# EAGLE board Mk4 Prototype (EAGLE 9.0.1), part 1 of 2
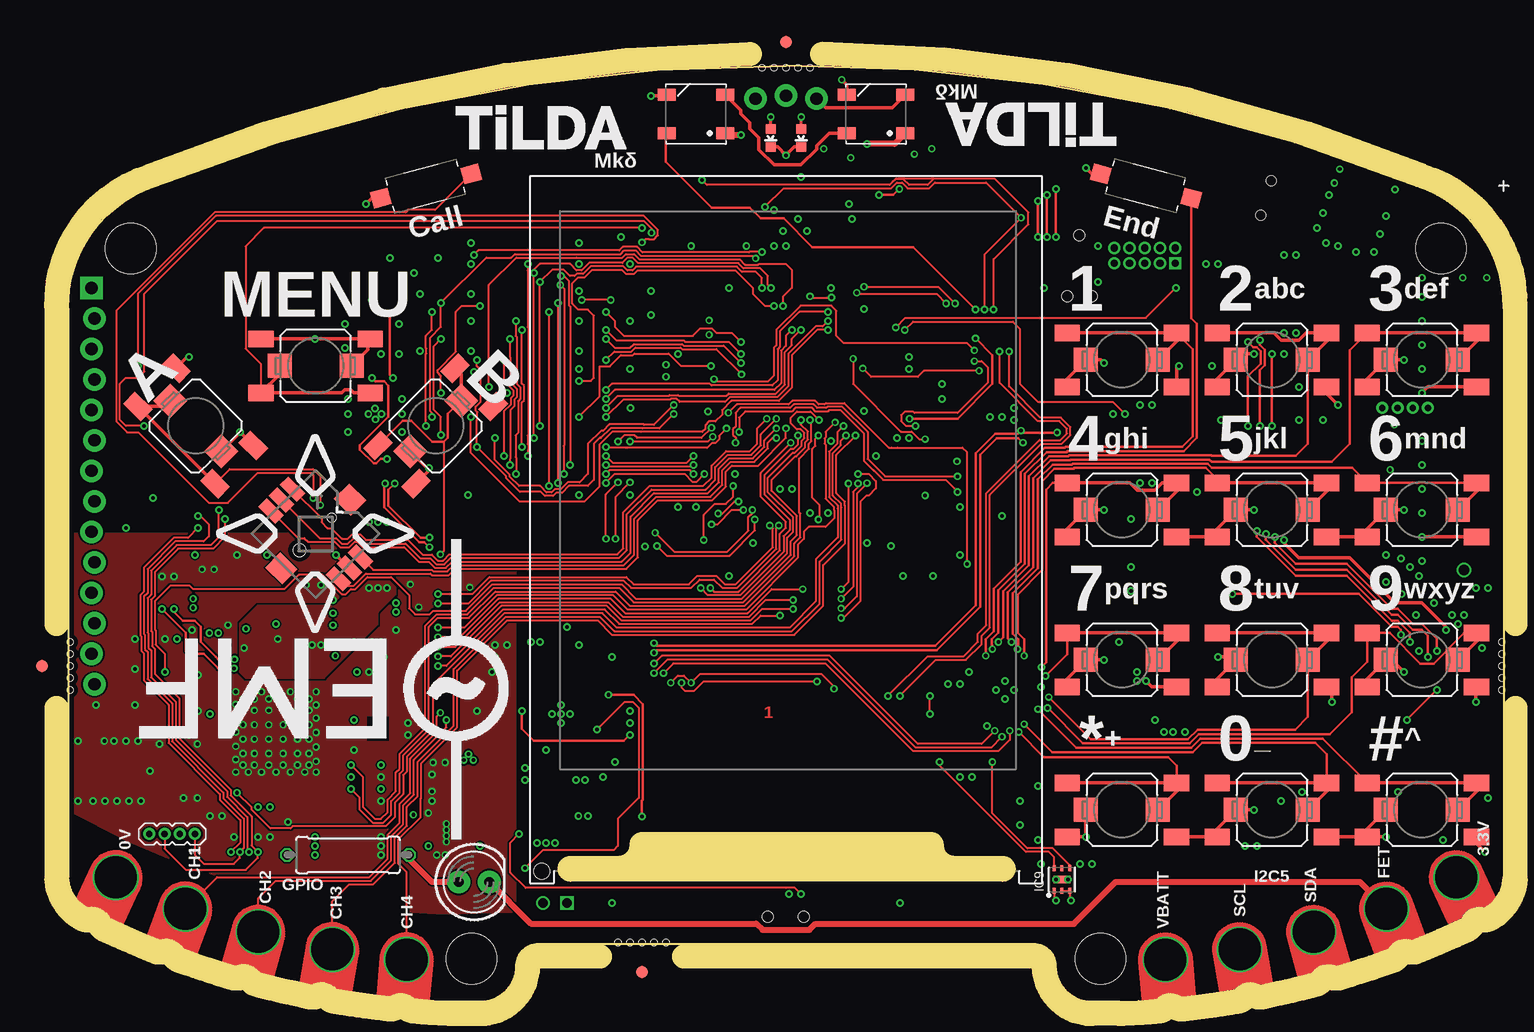
[diagram p4: board, top side]
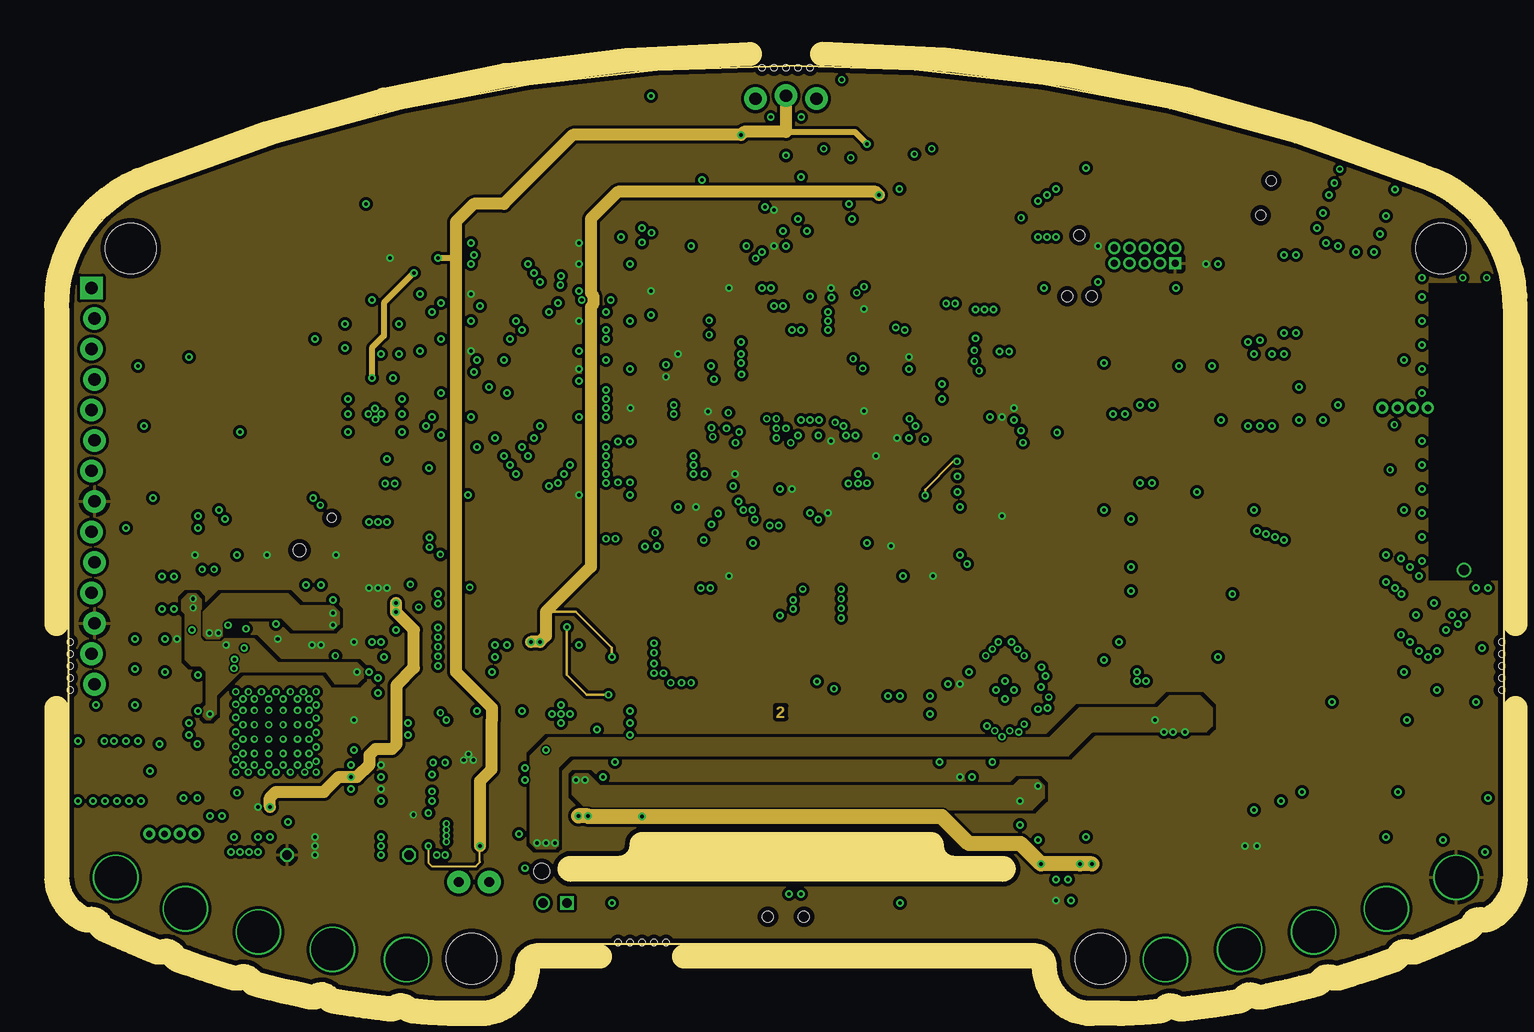
[diagram p5: board, inner layer 3V3@2]
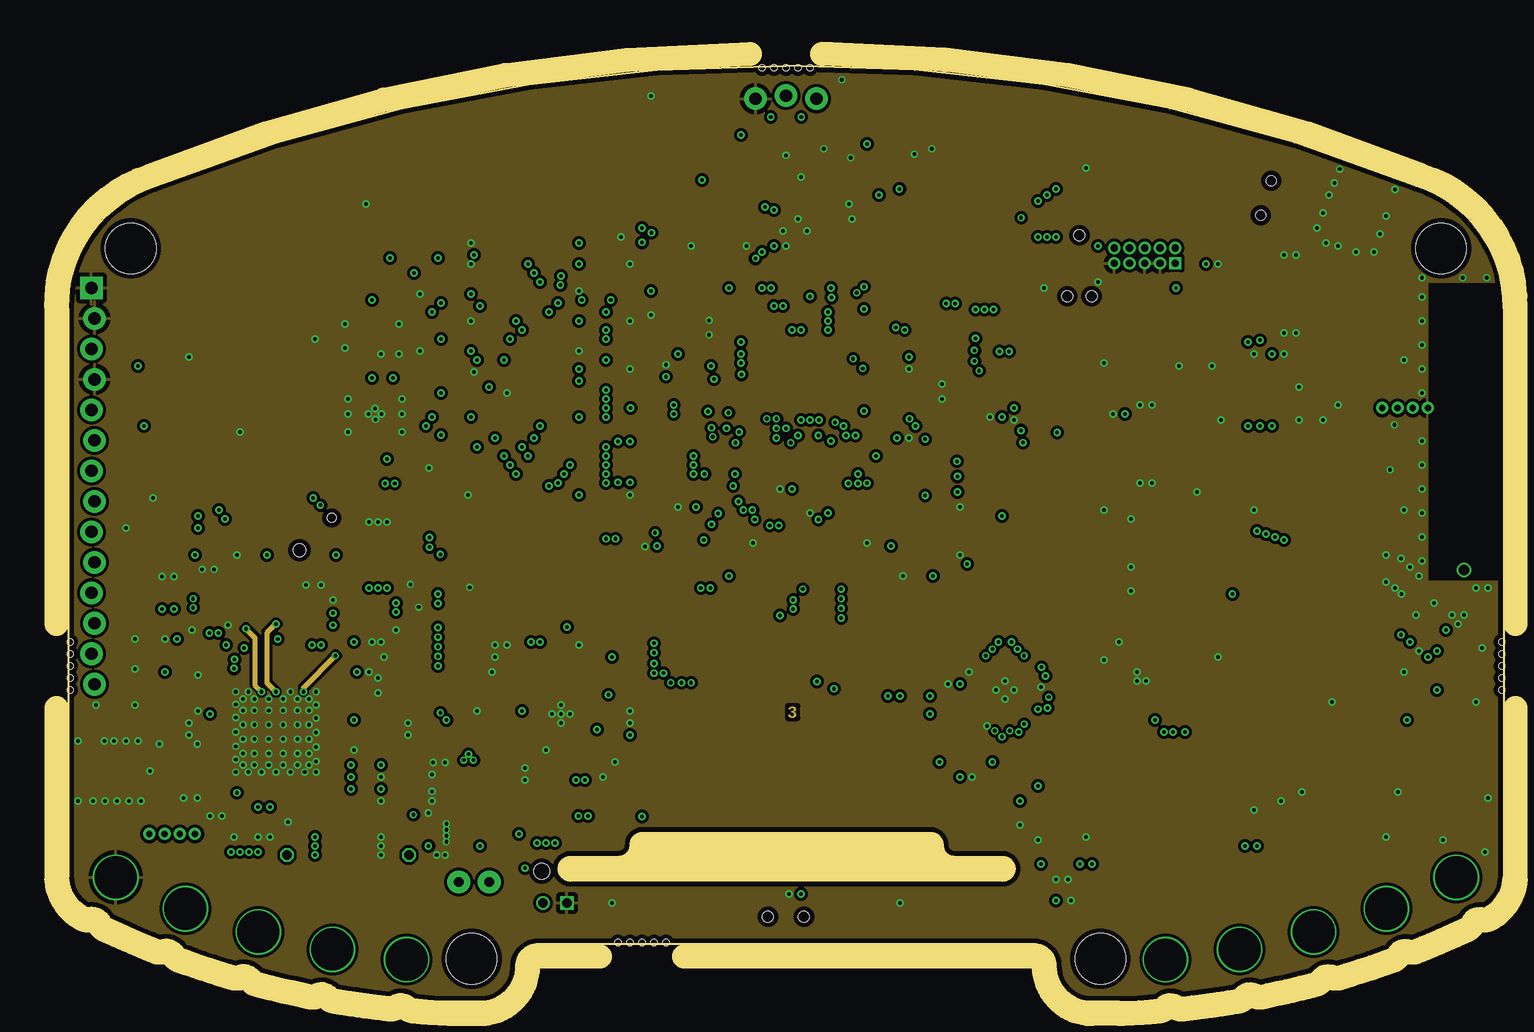
[diagram p6: board, inner layer GND@3]
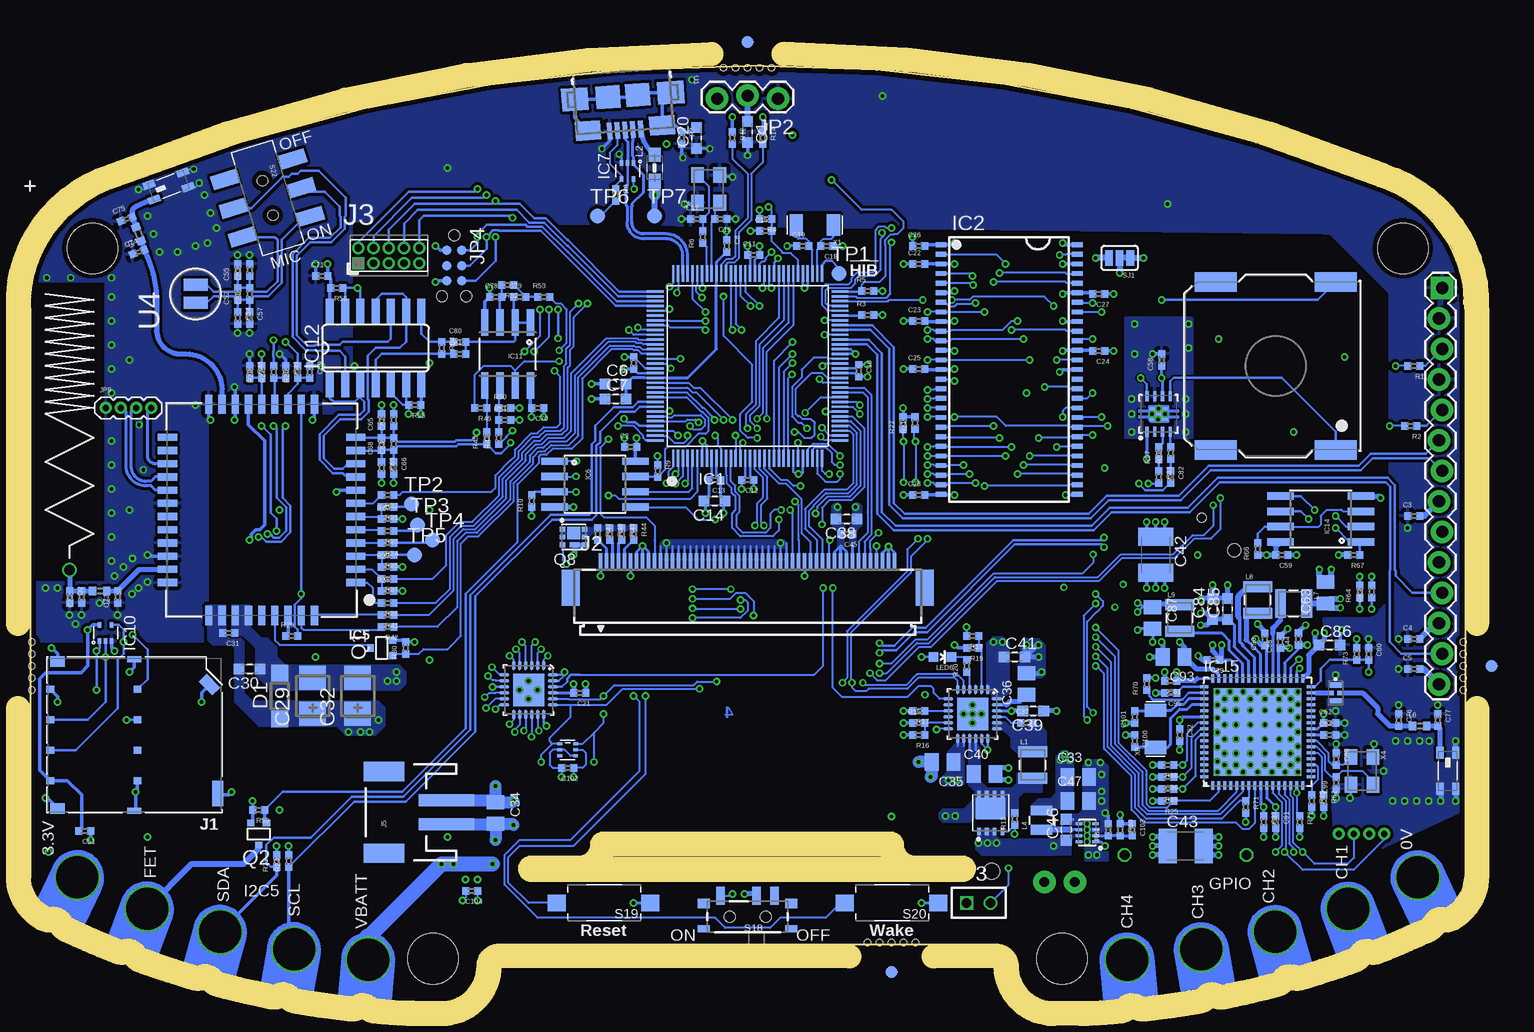
[diagram p7: board, bottom side, seen from below]

Size 119.6 x 78 mm. Coordinates in mm from the lower left corner, seen from the top.
Copper layers (1+2*15+16): Top 0.035mm / dielectric 0.22mm / 3V3@2 0.017mm / dielectric 1mm / GND@3 0.017mm / dielectric 0.22mm / Bottom 0.035mm
Design rules "little015mm  Round 4layer Newbury *": minimum track width 0.15mm, minimum drill 0.3mm, track to track 0.15mm, track to pad 0.15mm, pad to pad 0.15mm, via to via 0.15mm, smd to smd 0.15mm, copper to edge 0.4mm, drill to drill 0.3mm, minimum pad ring 0.15mm, minimum via ring 0.15mm, stop-mask expansion 0.1mm, vias tented up to drill 0.6mm, thermal gap 14mil
Net classes: 1 50R Single: width 0.4 mm, clearance 0.4 mm to class 0, clearance 0.4 mm; 2 90R Diff: width 0.25 mm, clearance 0.25 mm to class 0, clearance 0.4 mm to class 1, clearance 0.15 mm; 3 100R Diff: width 0.22 mm, clearance 0.25 mm to class 0, clearance 0.4 mm to class 1, clearance 0.25 mm to class 2, clearance 0.15 mm; 4 Audio: width 0.2 mm, clearance 0.25 mm to class 0, clearance 0.4 mm to class 1, clearance 0.25 mm to class 2, clearance 0.25 mm to class 3, clearance 0.15 mm
bRestrict: area 10.9,29.4 to 11.5,30.1

## Footprints (pad centres in the part's own frame; a part is rotated, then mirrored left to right if it is on the bottom)
2450AT18D0100 = smd 1 x 0.6: 1 -1.5,-0.65; 2 1.5,-0.65; 3 1.5,0.65; 4 -1.5,0.65
C0603K-SMALL = smd 0.889 x 0.889: 1 -0.875,0; 2 0.875,0
C0402-SMALLER = smd 0.6 x 0.6: 1 -0.5,0; 2 0.5,0
CT3528 = smd 2 x 2.2: + -1.5,0; - 1.5,0
C0805-N = smd 1.15 x 1.45: 1 -0.9,0; 2 0.9,0
C1210K = smd 1.5 x 2.9: 1 -1.5,0; 2 1.5,0
SOD123 = smd 1.4 x 1.4: A 1.9,0; C -1.9,0
R0402-SMALLER = smd 0.6 x 0.6: 1 -0.5,0; 2 0.5,0
FIDUCIAL-1X2.5-STOP = smd 1 x 1: 1 0,0
DEA202450BT = smd 0.45 x 1: GND@2 0.65,0; GND@4 -0.65,0 | smd 0.35 x 0.35: IN 0,-0.325; OUT 0,0.325
QFP128-0.4 = smd 0.2 x 1.4: 1 -6.2,-7.7; 2 -5.8,-7.7; 3 -5.4,-7.7; 4 -5,-7.7; 5 -4.6,-7.7; 6 -4.2,-7.7; 7 -3.8,-7.7; 8 -3.4,-7.7; 9 -3,-7.7; 10 -2.6,-7.7; 11 -2.2,-7.7; 12 -1.8,-7.7; 13 -1.4,-7.7; 14 -1,-7.7; 15 -0.6,-7.7; 16 -0.2,-7.7; 17 0.2,-7.7; 18 0.6,-7.7; 19 1,-7.7; 20 1.4,-7.7; 21 1.8,-7.7; 22 2.2,-7.7; 23 2.6,-7.7; 24 3,-7.7; 25 3.4,-7.7; 26 3.8,-7.7; 27 4.2,-7.7; 28 4.6,-7.7; 29 5,-7.7; 30 5.4,-7.7; 31 5.8,-7.7; 32 6.2,-7.7; 65 6.2,7.7; 66 5.8,7.7; 67 5.4,7.7; 68 5,7.7; 69 4.6,7.7; 70 4.2,7.7; 71 3.8,7.7; 72 3.4,7.7; 73 3,7.7; 74 2.6,7.7; 75 2.2,7.7; 76 1.8,7.7; 77 1.4,7.7; 78 1,7.7; 79 0.6,7.7; 80 0.2,7.7; 81 -0.2,7.7; 82 -0.6,7.7; 83 -1,7.7; 84 -1.4,7.7; 85 -1.8,7.7; 86 -2.2,7.7; 87 -2.6,7.7; 88 -3,7.7; 89 -3.4,7.7; 90 -3.8,7.7; 91 -4.2,7.7; 92 -4.6,7.7; 93 -5,7.7; 94 -5.4,7.7; 95 -5.8,7.7; 96 -6.2,7.7 | smd 1.4 x 0.2: 33 7.7,-6.2; 34 7.7,-5.8; 35 7.7,-5.4; 36 7.7,-5; 37 7.7,-4.6; 38 7.7,-4.2; 39 7.7,-3.8; 40 7.7,-3.4; 41 7.7,-3; 42 7.7,-2.6; 43 7.7,-2.2; 44 7.7,-1.8; 45 7.7,-1.4; 46 7.7,-1; 47 7.7,-0.6; 48 7.7,-0.2; 49 7.7,0.2; 50 7.7,0.6; 51 7.7,1; 52 7.7,1.4; 53 7.7,1.8; 54 7.7,2.2; 55 7.7,2.6; 56 7.7,3; 57 7.7,3.4; 58 7.7,3.8; 59 7.7,4.2; 60 7.7,4.6; 61 7.7,5; 62 7.7,5.4; 63 7.7,5.8; 64 7.7,6.2; 97 -7.7,6.2; 98 -7.7,5.8; 99 -7.7,5.4; 100 -7.7,5; 101 -7.7,4.6; 102 -7.7,4.2; 103 -7.7,3.8; 104 -7.7,3.4; 105 -7.7,3; 106 -7.7,2.6; 107 -7.7,2.2; 108 -7.7,1.8; 109 -7.7,1.4; 110 -7.7,1; 111 -7.7,0.6; 112 -7.7,0.2; 113 -7.7,-0.2; 114 -7.7,-0.6; 115 -7.7,-1; 116 -7.7,-1.4; 117 -7.7,-1.8; 118 -7.7,-2.2; 119 -7.7,-2.6; 120 -7.7,-3; 121 -7.7,-3.4; 122 -7.7,-3.8; 123 -7.7,-4.2; 124 -7.7,-4.6; 125 -7.7,-5; 126 -7.7,-5.4; 127 -7.7,-5.8; 128 -7.7,-6.2
TSOP54-400 = smd 0.4 x 0.9: 1 -10.4,-5.68; 2 -9.6,-5.68; 3 -8.8,-5.68; 4 -8,-5.68; 5 -7.2,-5.68; 6 -6.4,-5.68; 7 -5.6,-5.68; 8 -4.8,-5.68; 9 -4,-5.68; 10 -3.2,-5.68; 11 -2.4,-5.68; 12 -1.6,-5.68; 13 -0.8,-5.68; 14 0,-5.68; 15 0.8,-5.68; 16 1.6,-5.68; 17 2.4,-5.68; 18 3.2,-5.68; 19 4,-5.68; 20 4.8,-5.68; 21 5.6,-5.68; 22 6.4,-5.68; 23 7.2,-5.68; 24 8,-5.68; 25 8.8,-5.68; 26 9.6,-5.68; 27 10.4,-5.68; 28 10.4,5.68; 29 9.6,5.68; 30 8.8,5.68; 31 8,5.68; 32 7.2,5.68; 33 6.4,5.68; 34 5.6,5.68; 35 4.8,5.68; 36 4,5.68; 37 3.2,5.68; 38 2.4,5.68; 39 1.6,5.68; 40 0.8,5.68; 41 0,5.68; 42 -0.8,5.68; 43 -1.6,5.68; 44 -2.4,5.68; 45 -3.2,5.68; 46 -4,5.68; 47 -4.8,5.68; 48 -5.6,5.68; 49 -6.4,5.68; 50 -7.2,5.68; 51 -8,5.68; 52 -8.8,5.68; 53 -9.6,5.68; 54 -10.4,5.68
VSON-HR = smd 0.55 x 0.25: 1 -0.675,0.75; 2 -0.675,0.25; 3 -0.675,-0.25; 4 -0.675,-0.75; 5 0.675,-0.75; 6 0.675,-0.25; 7 0.675,0.25; 8 0.675,0.75
QFN-24 = smd 0.85 x 0.25: 1 -2.05,1.25; 2 -2.05,0.75; 3 -2.05,0.25; 4 -2.05,-0.25; 5 -2.05,-0.75; 6 -2.05,-1.25; 13 2.05,-1.25; 14 2.05,-0.75; 15 2.05,-0.25; 16 2.05,0.25; 17 2.05,0.75; 18 2.05,1.25 | smd 0.25 x 0.9: 7 -1.25,-2.025; 8 -0.75,-2.025; 9 -0.25,-2.025; 10 0.25,-2.025; 11 0.75,-2.025; 12 1.25,-2.025; 19 1.25,2.025; 20 0.75,2.025; 21 0.25,2.025; 22 -0.25,2.025; 23 -0.75,2.025; 24 -1.25,2.025 | smd 2.7 x 2.6: 25 0,0
SIM800C = smd 1.6 x 0.6: 1 -7.85,6.05; 2 -7.85,4.95; 3 -7.85,3.85; 4 -7.85,2.75; 5 -7.85,1.65; 6 -7.85,0.55; 7 -7.85,-0.55; 8 -7.85,-1.65; 9 -7.85,-2.75; 10 -7.85,-3.85; 11 -7.85,-4.95; 12 -7.85,-6.05; 22 7.85,-6.05; 23 7.85,-4.95; 24 7.85,-3.85; 25 7.85,-2.75; 26 7.85,-1.65; 27 7.85,-0.55; 28 7.85,0.55; 29 7.85,1.65; 30 7.85,2.75; 31 7.85,3.85; 32 7.85,4.95; 33 7.85,6.05 | smd 0.6 x 1.6: 13 -4.4,-8.8; 14 -3.3,-8.8; 15 -2.2,-8.8; 16 -1.1,-8.8; 17 0,-8.8; 18 1.1,-8.8; 19 2.2,-8.8; 20 3.3,-8.8; 21 4.4,-8.8; 34 4.4,8.8; 35 3.3,8.8; 36 2.2,8.8; 37 1.1,8.8; 38 0,8.8; 39 -1.1,8.8; 40 -2.2,8.8; 41 -3.3,8.8; 42 -4.4,8.8
SO08-EIAJ = smd 0.61 x 2.21: 1 -1.905,-3.378; 2 -0.635,-3.378; 3 0.635,-3.378; 4 1.905,-3.378; 5 1.905,3.353; 6 0.635,3.353; 7 -0.635,3.353; 8 -1.905,3.353
DRL-5 = smd 0.3 x 0.45: 1 -0.5,-0.675; 2 0,-0.675; 3 0.5,-0.675; 4 0.5,0.675; 5 -0.5,0.675
USON-6 = smd 0.5 x 0.25: 1 -0.95,0.65; 2 -0.95,0; 3 -0.95,-0.65; 4 0.95,-0.65; 5 0.95,0; 6 0.95,0.65 | smd 0.65 x 1.35: PAD 0,0
SO08 = smd 0.61 x 2.21: 1 -1.905,-2.616; 2 -0.635,-2.616; 3 0.635,-2.616; 4 1.905,-2.616; 5 1.905,2.616; 6 0.635,2.616; 7 -0.635,2.616; 8 -1.905,2.616
SO14 = smd 0.66 x 2.032: 1 -3.81,-3.073; 2 -2.54,-3.073; 3 -1.27,-3.073; 4 0,-3.073; 5 1.27,-3.073; 6 2.54,-3.073; 7 3.81,-3.073; 8 3.81,3.073; 9 2.54,3.073; 10 1.27,3.073; 11 0,3.073; 12 -1.27,3.073; 13 -2.54,3.073; 14 -3.81,3.073
VSON-8 = smd 0.85 x 0.28: 1 -1.475,0.975; 2 -1.475,0.325; 3 -1.475,-0.325; 4 -1.475,-0.975; 5 1.475,-0.975; 6 1.475,-0.325; 7 1.475,0.325; 8 1.475,0.975 | smd 1.15 x 1.5: PAD 0,0
VQFN-64 = smd 0.25 x 0.7: 1 -3.75,-4.45; 2 -3.25,-4.45; 3 -2.75,-4.45; 4 -2.25,-4.45; 5 -1.75,-4.45; 6 -1.25,-4.45; 7 -0.75,-4.45; 8 -0.25,-4.45; 9 0.25,-4.45; 10 0.75,-4.45; 11 1.25,-4.45; 12 1.75,-4.45; 13 2.25,-4.45; 14 2.75,-4.45; 15 3.25,-4.45; 16 3.75,-4.45; 33 3.75,4.45; 34 3.25,4.45; 35 2.75,4.45; 36 2.25,4.45; 37 1.75,4.45; 38 1.25,4.45; 39 0.75,4.45; 40 0.25,4.45; 41 -0.25,4.45; 42 -0.75,4.45; 43 -1.25,4.45; 44 -1.75,4.45; 45 -2.25,4.45; 46 -2.75,4.45; 47 -3.25,4.45; 48 -3.75,4.45 | smd 0.7 x 0.25: 17 4.45,-3.75; 18 4.45,-3.25; 19 4.45,-2.75; 20 4.45,-2.25; 21 4.45,-1.75; 22 4.45,-1.25; 23 4.45,-0.75; 24 4.45,-0.25; 25 4.45,0.25; 26 4.45,0.75; 27 4.45,1.25; 28 4.45,1.75; 29 4.45,2.25; 30 4.45,2.75; 31 4.45,3.25; 32 4.45,3.75; 49 -4.45,3.75; 50 -4.45,3.25; 51 -4.45,2.75; 52 -4.45,2.25; 53 -4.45,1.75; 54 -4.45,1.25; 55 -4.45,0.75; 56 -4.45,0.25; 57 -4.45,-0.25; 58 -4.45,-0.75; 59 -4.45,-1.25; 60 -4.45,-1.75; 61 -4.45,-2.25; 62 -4.45,-2.75; 63 -4.45,-3.25; 64 -4.45,-3.75 | smd 7.3 x 7.3: PAD 0,0
MSIM-MOLEX-LWK = smd 0.65 x 0.55: C1 0.61,3.81; C2 0.61,1.27; C3 0.61,-1.27; C4 0.61,-3.81; C5 -6.65,3.81; C6 -6.65,1.27; C7 -6.65,-1.27; C8 -6.65,-3.81 | smd 1.2 x 0.89: GND1 0,6.125; GND2 0,-6.125 | smd 1.6 x 0.94 rotated 315: GND3 -12.67,-4.19 | smd 1.2 x 0.52: GND4 -6.39,6.31; GND5 -6.39,-6.31 | smd 0.94 x 2.1: GND6 -13.35,4.88
FH12-50S-0.5SH = smd 0.3 x 1.3: 1 -12.25,3.25; 2 -11.75,3.25; 3 -11.25,3.25; 4 -10.75,3.25; 5 -10.25,3.25; 6 -9.75,3.25; 7 -9.25,3.25; 8 -8.75,3.25; 9 -8.25,3.25; 10 -7.75,3.25; 11 -7.25,3.25; 12 -6.75,3.25; 13 -6.25,3.25; 14 -5.75,3.25; 15 -5.25,3.25; 16 -4.75,3.25; 17 -4.25,3.25; 18 -3.75,3.25; 19 -3.25,3.25; 20 -2.75,3.25; 21 -2.25,3.25; 22 -1.75,3.25; 23 -1.25,3.25; 24 -0.75,3.25; 25 -0.25,3.25; 26 0.25,3.25; 27 0.75,3.25; 28 1.25,3.25; 29 1.75,3.25; 30 2.25,3.25; 31 2.75,3.25; 32 3.25,3.25; 33 3.75,3.25; 34 4.25,3.25; 35 4.75,3.25; 36 5.25,3.25; 37 5.75,3.25; 38 6.25,3.25; 39 6.75,3.25; 40 7.25,3.25; 41 7.75,3.25; 42 8.25,3.25; 43 8.75,3.25; 44 9.25,3.25; 45 9.75,3.25; 46 10.25,3.25; 47 10.75,3.25; 48 11.25,3.25; 49 11.75,3.25; 50 12.25,3.25 | smd 1.5 x 3: 51 -14.75,1; 52 14.75,1
PINHEAD_2X05_127 = drill 0.6 pad 1.016 square: 1 -2.54,-0.635 | drill 0.6 pad 1.016: 2 -2.54,0.635; 3 -1.27,-0.635; 4 -1.27,0.635; 5 0,-0.635; 6 0,0.635; 7 1.27,-0.635; 8 1.27,0.635; 9 2.54,-0.635; 10 2.54,0.635
GSM-ANTENNA = drill 0.9: ANT 0,0
JST-2-SMD = smd 1 x 4.6: 1 -1,-3.7; 2 1,-3.7 | smd 1.6 x 3.4: NC1 -3.4,1.5; NC2 3.4,1.5
1X03_LOCK = drill 1.016 pad 1.88: 1 0,0.127; 2 2.54,-0.127; 3 5.08,0.127
1X02_2MM = drill 0.8 square: 1 0,0 | drill 0.8: 2 2,0
TC2030-MCP-NL = smd 0.787 x 0.787: 1 1.27,-0.635; 2 1.27,0.635; 3 2.54,-0.635; 4 2.54,0.635; 5 3.81,-0.635; 6 3.81,0.635 | hole 0.889: 0,0; 5.08,-1.016; 5.08,1.016
1X14_LOCK = drill 1.016 pad 1.88 square: 1 0,0.127 | drill 1.016 pad 1.88: 2 2.54,-0.127; 3 5.08,0.127; 4 7.62,-0.127; 5 10.16,0.127; 6 12.7,-0.127; 7 15.24,0.127; 8 17.78,-0.127; 9 20.32,0.127; 10 22.86,-0.127; 11 25.4,0.127; 12 27.94,-0.127; 13 30.48,0.127; 14 33.02,-0.127
1X04-1.27MM = drill 0.508 pad 1: 1 0,0; 2 1.27,0; 3 2.54,0; 4 3.81,0
1008 = smd 0.9 x 2.4: 1 -1.1,0; 2 1.1,0
WUERTH-0805 = smd 1.2 x 1: 1 -1.1,0; 2 1.1,0
L0402 = smd 0.6 x 0.7: 1 -0.6,0; 2 0.6,0
0806 = smd 0.8 x 1.8: 1 -0.8,0; 2 0.8,0
ER-TFT024-3 = hole 1.3: -20.35,-22.6
WS2812B = smd 1.5 x 1: 1 -2.45,1.6; 2 -2.45,-1.6; 3 2.45,-1.6; 4 2.45,1.6
LED-0603-CORRECT = smd 0.8 x 0.8: A 0.75,0; C -0.75,0
LED5MM = drill 0.813 pad 1.88: A -1.27,0; K 1.27,0
TILDA_MK4_OUTLINE = drill 3.5: 3V3 55.856,10.386; CH1 -31.617,3.538; CH2 -37.798,4.386; CH3 -43.962,5.833; CH4 -50.042,7.771; FET 50.042,7.771; GND -55.856,10.386; SCL 37.798,4.386; SDA 43.962,5.833; VBATT 31.617,3.538 | hole 4.2: 26.2,3.6; -26.2,3.6; 54.6,62.8; -54.6,62.8 | hole 0.5: 59.65,30; 59.65,29; 59.65,28; 59.65,27; 59.65,26; -10,4.95; -11,4.95; -12,4.95; -13,4.95; -14,4.95; -59.65,26; -59.65,27; -59.65,28; -59.65,29; -59.65,30; -2,77.85; -1,77.85; 0,77.85; 1,77.85; 2,77.85
SC70-3-R = smd 0.6 x 0.55: 1 -0.65,-0.925; 2 0.65,-0.925; 3 0,0.925
Q3A = smd 0.3 x 0.6: 1 -0.975,-1.55; 2 -0.325,-1.55; 3 0.325,-1.55; 4 0.975,-1.55; 5 0.975,1.55; 6 0.325,1.55; 7 -0.325,1.55; 8 -0.975,1.55 | smd 2.45 x 1.775: EP 0,0.375
Q2 = smd 0.4 x 0.455: 1 -0.65,-0.922; 2 0,-0.922; 3 0.65,-0.922; 4 0.65,0.922; 5 0,0.922; 6 -0.65,0.922 | smd 1.05 x 1.1: EP1 -0.325,0 | smd 0.4 x 0.85: EP2 0.65,0.1
0309/10 = drill 0.813 octagon: 1 -5.08,0; 2 5.08,0
SKPMAPE010-COMBINED = smd 2 x 2: 1 -3,0; 2 3,0 | smd 2.1 x 1.4: A1 -4.55,-2.25; A2 4.55,-2.25; B1 -4.55,2.25; B2 4.55,2.25
TACTILE_SWITCH_SMD_3X6X2.5H = smd 1.5 x 1.4: 1 -3.9,0; 2 3.9,0
SWITCH-SPST-SMD-A = smd 0.7 x 1.5: 1 -2.25,-1.75; 2 -0.75,-1.75; 3 2.25,-1.75 | smd 1 x 0.6: GND1 -3.65,1; GND3 3.65,1 | smd 1 x 0.8: GND2 -3.65,-1.1; GND4 3.65,-1.1 | hole 0.9: -1.5,0; 1.5,0
AYZ-JS-COMBINED = smd 1.2 x 2.2: 1 -2.5,2.975; 2 0,2.975; 3 2.5,2.975; 4 -2.5,-2.975; 5 0,-2.975; 6 2.5,-2.975 | hole 0.85: 1.5,0; -1.5,0
SJ_3 = smd 0.635 x 1.27: 1 -0.889,0; 2 0,0; 3 0.889,0
JOYSTICK_MULTICOMP_NOSILK = smd 2 x 1: A -4,1.275; B 4,1.275; C -4,-1.275; COM 4,0; CTR -4,0; D 4,-1.275 | smd 2 x 1.8: NC 0,4.05; NC@0 0,-4.05 | hole 0.75: 0,1.9 | hole 1.05: 0,-1.9
B1,27 = smd 1.27 x 1.27: TP 0,0
USB-AB-MICRO-SMD_LWK = smd 1.4 x 0.4: D+ 2.85,0; D- 2.85,0.65; GND 2.85,-1.3; ID 2.85,-0.65; VBUS 2.85,1.3 | smd 1.6 x 2.1: SHIELD 2.675,3.1; SHIELD@5 2.675,-3.1 | smd 1.9 x 2: SHIELD@0 0,1.25; SHIELD@1 0,-1.25 | smd 1.9 x 2.2: SHIELD@2 0,-4; SHIELD@3 0,4
SOT563 = smd 0.25 x 0.4: 1 -0.5,-0.66; 2 0,-0.66; 3 0.5,-0.66; 4 0.5,0.66; 5 0,0.66; 6 -0.5,0.67
MIC-SMD-4MM = smd 1 x 2: + -0.75,0; - 0.75,0
SPEAKER-15MM-SMD = smd 1.6 x 3.5: + -7,-5; - 7,-5; DUMMY@3 7,5; DUMMY@4 -7,5
RESONATOR_EPSON_FC_145 = smd 1.1 x 1.8: P$1 -1.55,0; P$2 1.55,0
CRYSTAL-3.2-2.5 = smd 1.3 x 1.05: 1 -1.15,-0.925; 2 1.15,-0.925; 3 1.15,0.925; 4 -1.15,0.925

## Placement (x,y rotation side)
ANT1  2450AT18D0100  [2450AT18D0100]  1.45,19.25 270 bottom
ANT2  2450AT18D0100  [2450AT18D0100]  108.05,68 20 bottom
ARTWORK1  ARTWORK_JOYSTICK  [TILDA_ARTWORK_JOYSTICK]  20.6,39 0 top
ARTWORK2  ARTWORK_KEYPAD  [TILDA_ARTWORK_KEYPAD]  59.8,0 0 top
BATT  1000mAh JST-PH  [BATTERY-32X50]  59.3,12 90 top
C1  0603/1u/6V3/X5R  [C0603K-SMALL]  59.8,72.5 270 bottom
C2  0402/100n/10V/X5R  [C0402-SMALLER]  69.55,46.25 0 bottom
C3  0402/100n/10V/X5R  [C0402-SMALLER]  4.3,40.5 0 bottom
C4  0402/100n/10V/X5R  [C0402-SMALLER]  4.3,30.25 0 bottom
C5  0402/100n/10V/X5R  [C0402-SMALLER]  4.3,27.75 0 bottom
C6  0603/2u2/6V3/X5R  [C0603K-SMALL]  70.8,51.5 0 bottom
C7  0603/1u/6V3/X5R  [C0603K-SMALL]  70.8,50.25 0 bottom
C8  0402/100n/10V/X5R  [C0402-SMALLER]  61.55,63 270 bottom
C9  0402/100n/10V/X5R  [C0402-SMALLER]  69.3,53.25 90 bottom
C10  0402/100n/10V/X5R  [C0402-SMALLER]  50.55,52.6 270 bottom
C11  0402/100n/10V/X5R  [C0402-SMALLER]  59.3,62.25 0 bottom
C12  0402/100n/10V/X5R  [C0402-SMALLER]  59.8,43.5 180 bottom
C13  0402/100n/10V/X5R  [C0402-SMALLER]  62.55,43.5 180 bottom
C14  0603/1u/6V3/X5R  [C0603K-SMALL]  62.55,41.75 180 bottom
C15  0402/100n/10V/X5R  [C0402-SMALLER]  58.3,64.25 0 bottom
C16  0402/12p/50V/C0G  [C0402-SMALLER]  62.05,65.25 180 bottom
C17  0402/12p/50V/C0G  [C0402-SMALLER]  64.05,65.25 0 bottom
C18  0402/12p/50V/C0G  [C0402-SMALLER]  53.2,63 180 bottom
C19  0402/12p/50V/C0G  [C0402-SMALLER]  55.2,63 0 bottom
C20  0603/3n3/50V/X7R  [C0603K-SMALL]  64.05,72 90 bottom
C21  0402/100n/10V/X5R  [C0402-SMALLER]  73.8,25.75 180 bottom
C22  0402/100n/10V/X5R  [C0402-SMALLER]  45.55,61.5 0 bottom
C23  0402/100n/10V/X5R  [C0402-SMALLER]  45.55,56.75 0 bottom
C24  0402/100n/10V/X5R  [C0402-SMALLER]  30.55,54.25 180 bottom
C25  0402/100n/10V/X5R  [C0402-SMALLER]  45.55,52.75 0 bottom
C26  0402/100n/10V/X5R  [C0402-SMALLER]  45.55,63 0 bottom
C27  0402/100n/10V/X5R  [C0402-SMALLER]  30.55,59 180 bottom
C28  0402/100n/10V/X5R  [C0402-SMALLER]  45.55,42.25 0 bottom
C29  1411/100u/10V/Tant  [CT3528]  96.05,25.5 90 bottom
C30  0603/4u7/10V/X5R  [C0603K-SMALL]  101.3,27.75 180 bottom
C31  0402/100n/10V/X5R  [C0402-SMALLER]  103.05,30.75 180 bottom
C32  1411/100u/10V/Tant  [CT3528]  92.3,25.5 90 bottom
C33  0805/10u/10V/X5R  [C0805-N]  32.25,18.75 0 bottom
C34  0805/10u/10V/X5R  [C0805-N]  80.8,15.75 270 bottom
C35  0805/10u/10V/X5R  [C0805-N]  43.55,20 180 bottom
C36  0805/10u/10V/X5R  [C0805-N]  36.55,26.5 90 bottom
C37  0402/47n/10V/X5R  [C0402-SMALLER]  36.55,23.25 0 bottom
C38  0603/4u7/10V/X5R  [C0603K-SMALL]  51.55,40.25 180 bottom
C39  0603/4u7/10V/X5R  [C0603K-SMALL]  36,24.25 180 bottom
C40  0805/10u/10V/X5R  [C0805-N]  40.05,19 0 bottom
C41  0603/1u/6V3/X5R  [C0603K-SMALL]  37.55,28.75 0 bottom
C42  1210/100u/6V3/X5R  [C1210K]  25.8,37.25 270 bottom
C43  1210/100u/6V3/X5R  [C1210K]  23.3,13 0 bottom
C44  0402/100n/10V/X5R  [C0402-SMALLER]  13.9,30.25 90 bottom
C45  0402/100n/10V/X5R  [C0402-SMALLER]  51.55,39 180 bottom
C46  0603/4u7/10V/X5R  [C0603K-SMALL]  33.25,14.35 90 bottom
C47  0805/10u/10V/X5R  [C0805-N]  32.25,16.75 0 bottom
C48  0402/22p/10V/C0G  [C0402-SMALLER]  101.3,52.5 270 bottom
C49  0402/22p/10V/C0G  [C0402-SMALLER]  98.3,52.5 270 bottom
C50  0402/22p/10V/C0G  [C0402-SMALLER]  96.3,52.5 270 bottom
C51  0402/100n/10V/X5R  [C0402-SMALLER]  115.05,14.25 180 bottom
C52  0402/33p/50V/C0G  [C0402-SMALLER]  102.3,59 90 bottom
C53  0402/10p/50V/C0G  [C0402-SMALLER]  101.3,61 90 bottom
C54  0402/33p/50V/C0G  [C0402-SMALLER]  102.3,57 270 bottom
C55  0402/33p/50V/C0G  [C0402-SMALLER]  102.3,61 90 bottom
C56  0402/10p/50V/C0G  [C0402-SMALLER]  101.3,59 90 bottom
C57  0402/10p/50V/C0G  [C0402-SMALLER]  101.3,57 270 bottom
C58  0402/100n/10V/X5R  [C0402-SMALLER]  25.3,53.5 90 bottom
C59  0402/100n/10V/X5R  [C0402-SMALLER]  15.3,37.25 180 bottom
C60  0402/100n/10V/X5R  [C0402-SMALLER]  8.05,29 270 bottom
C61  0402/100n/10V/X5R  [C0402-SMALLER]  24.55,26.75 180 bottom
C62  0402/100n/10V/X5R  [C0402-SMALLER]  11.3,23.25 0 bottom
C63  0805/10u/10V/X5R  [C0805-N]  11.65,34.1 90 bottom
C64  0402/33p/50V/C0G  [C0402-SMALLER]  89.3,46.5 90 bottom
C65  0402/10p/50V/C0G  [C0402-SMALLER]  90.3,48.5 90 bottom
C66  0402/33p/50V/C0G  [C0402-SMALLER]  89.3,44.5 270 bottom
C67  0402/33p/50V/C0G  [C0402-SMALLER]  89.3,48.5 90 bottom
C68  0402/10p/50V/C0G  [C0402-SMALLER]  90.3,46.5 90 bottom
C69  0402/10p/50V/C0G  [C0402-SMALLER]  90.3,44.5 270 bottom
C70  0402/100n/10V/X5R  [C0402-SMALLER]  77.3,49.5 180 bottom
C71  0402/100n/10V/X5R  [C0402-SMALLER]  95.3,60.5 0 bottom
C72  [C0402-SMALLER]  112.3,33.75 90 bottom
C73  [C0402-SMALLER]  115.3,33.75 90 bottom
C74  [C0402-SMALLER]  110.55,62.5 20 bottom
C75  [C0402-SMALLER]  111.55,65.25 20 bottom
C76  [C0402-SMALLER]  5.55,23.5 270 bottom
C77  [C0402-SMALLER]  2.3,23.5 270 bottom
C78  0402/1n/10V/X5R  [C0402-SMALLER]  80.8,58.75 0 bottom
C79  0402/2n2/10V/X5R  [C0402-SMALLER]  78.8,58.75 0 bottom
C80  0402/100n/10V/X5R  [C0402-SMALLER]  83.8,55 0 bottom
C81  0402/100n/10V/X5R  [C0402-SMALLER]  83.8,54 0 bottom
C82  0402/220n/6V/X5R  [C0402-SMALLER]  24.55,43.75 270 bottom
C83  0402/220n/6V/X5R  [C0402-SMALLER]  25.55,43.75 270 bottom
C84  0603/22u/4V/X5R  [C0603K-SMALL]  21.05,32.75 90 bottom
C85  0603/22u/4V/X5R  [C0603K-SMALL]  19.8,32.75 90 bottom
C86  0603/1u/6V3/X5R  [C0603K-SMALL]  11.3,29.75 0 bottom
C87  0805/10u/10V/X5R  [C0805-N]  26.05,32 270 bottom
C88  0402/4u7/6V3/X5R  [C0402-SMALLER]  15.4,30 90 bottom
C89  0402/4u7/6V3/X5R  [C0402-SMALLER]  21,28.5 180 bottom
C90  0402/4u7/6V3/X5R  [C0402-SMALLER]  16.7,30.2 90 bottom
C91  0402/100n/10V/X5R  [C0402-SMALLER]  15.8,15 270 bottom
C92  0402/100n/10V/X5R  [C0402-SMALLER]  23.8,22.25 270 bottom
C93  0805/10u/10V/X5R  [C0805-N]  24.3,28.75 180 bottom
C94  0402/100n/10V/X5R  [C0402-SMALLER]  11.3,22.25 0 bottom
C95  0402/100n/10V/X5R  [C0402-SMALLER]  24.55,25.75 180 bottom
C96  0402/100n/10V/X5R  [C0402-SMALLER]  24.8,18.75 180 bottom
C97  0402/100n/10V/X5R  [C0402-SMALLER]  16.8,15 270 bottom
C98  0402/12p/50V/C0G  [C0402-SMALLER]  10.75,20.25 270 bottom
C99  0402/12p/50V/C0G  [C0402-SMALLER]  10.75,18.25 90 bottom
C100  0402/12p/50V/C0G  [C0402-SMALLER]  27.55,21.75 270 bottom
C101  0402/12p/50V/C0G  [C0402-SMALLER]  27.55,23.75 90 bottom
C102  0402/100n/10V/X5R  [C0402-SMALLER]  74.8,19.5 180 bottom
C103  0402/120p/50V/C0G  [C0402-SMALLER]  27.75,14.35 270 bottom
C104  0402/100n/10V/X5R  [C0402-SMALLER]  82.8,9.25 180 bottom
D1  MMSZ5231BT1G  [SOD123]  98.8,25.5 90 bottom
D2  LXES15AAA1-153  [R0402-SMALLER]  116.3,33.75 270 bottom
FID1  FIDUCIAL1X2.5-STOP  [FIDUCIAL-1X2.5-STOP]  47.8,2.5 270 top
FID2  FIDUCIAL1X2.5-STOP  [FIDUCIAL-1X2.5-STOP]  -2.2,28 180 bottom
FID3  FIDUCIAL1X2.5-STOP  [FIDUCIAL-1X2.5-STOP]  59.8,80 180 top
FID4  FIDUCIAL1X2.5-STOP  [FIDUCIAL-1X2.5-STOP]  59.8,80 180 bottom
FID5  FIDUCIAL1X2.5-STOP  [FIDUCIAL-1X2.5-STOP]  -2.2,28 180 top
FID6  FIDUCIAL1X2.5-STOP  [FIDUCIAL-1X2.5-STOP]  47.8,2.5 270 bottom